# EasyEDA Pro project ProPrj_Avaota A1 八核 AIoT 开发板_2024-05-03.epro, board PCB1 (continued)
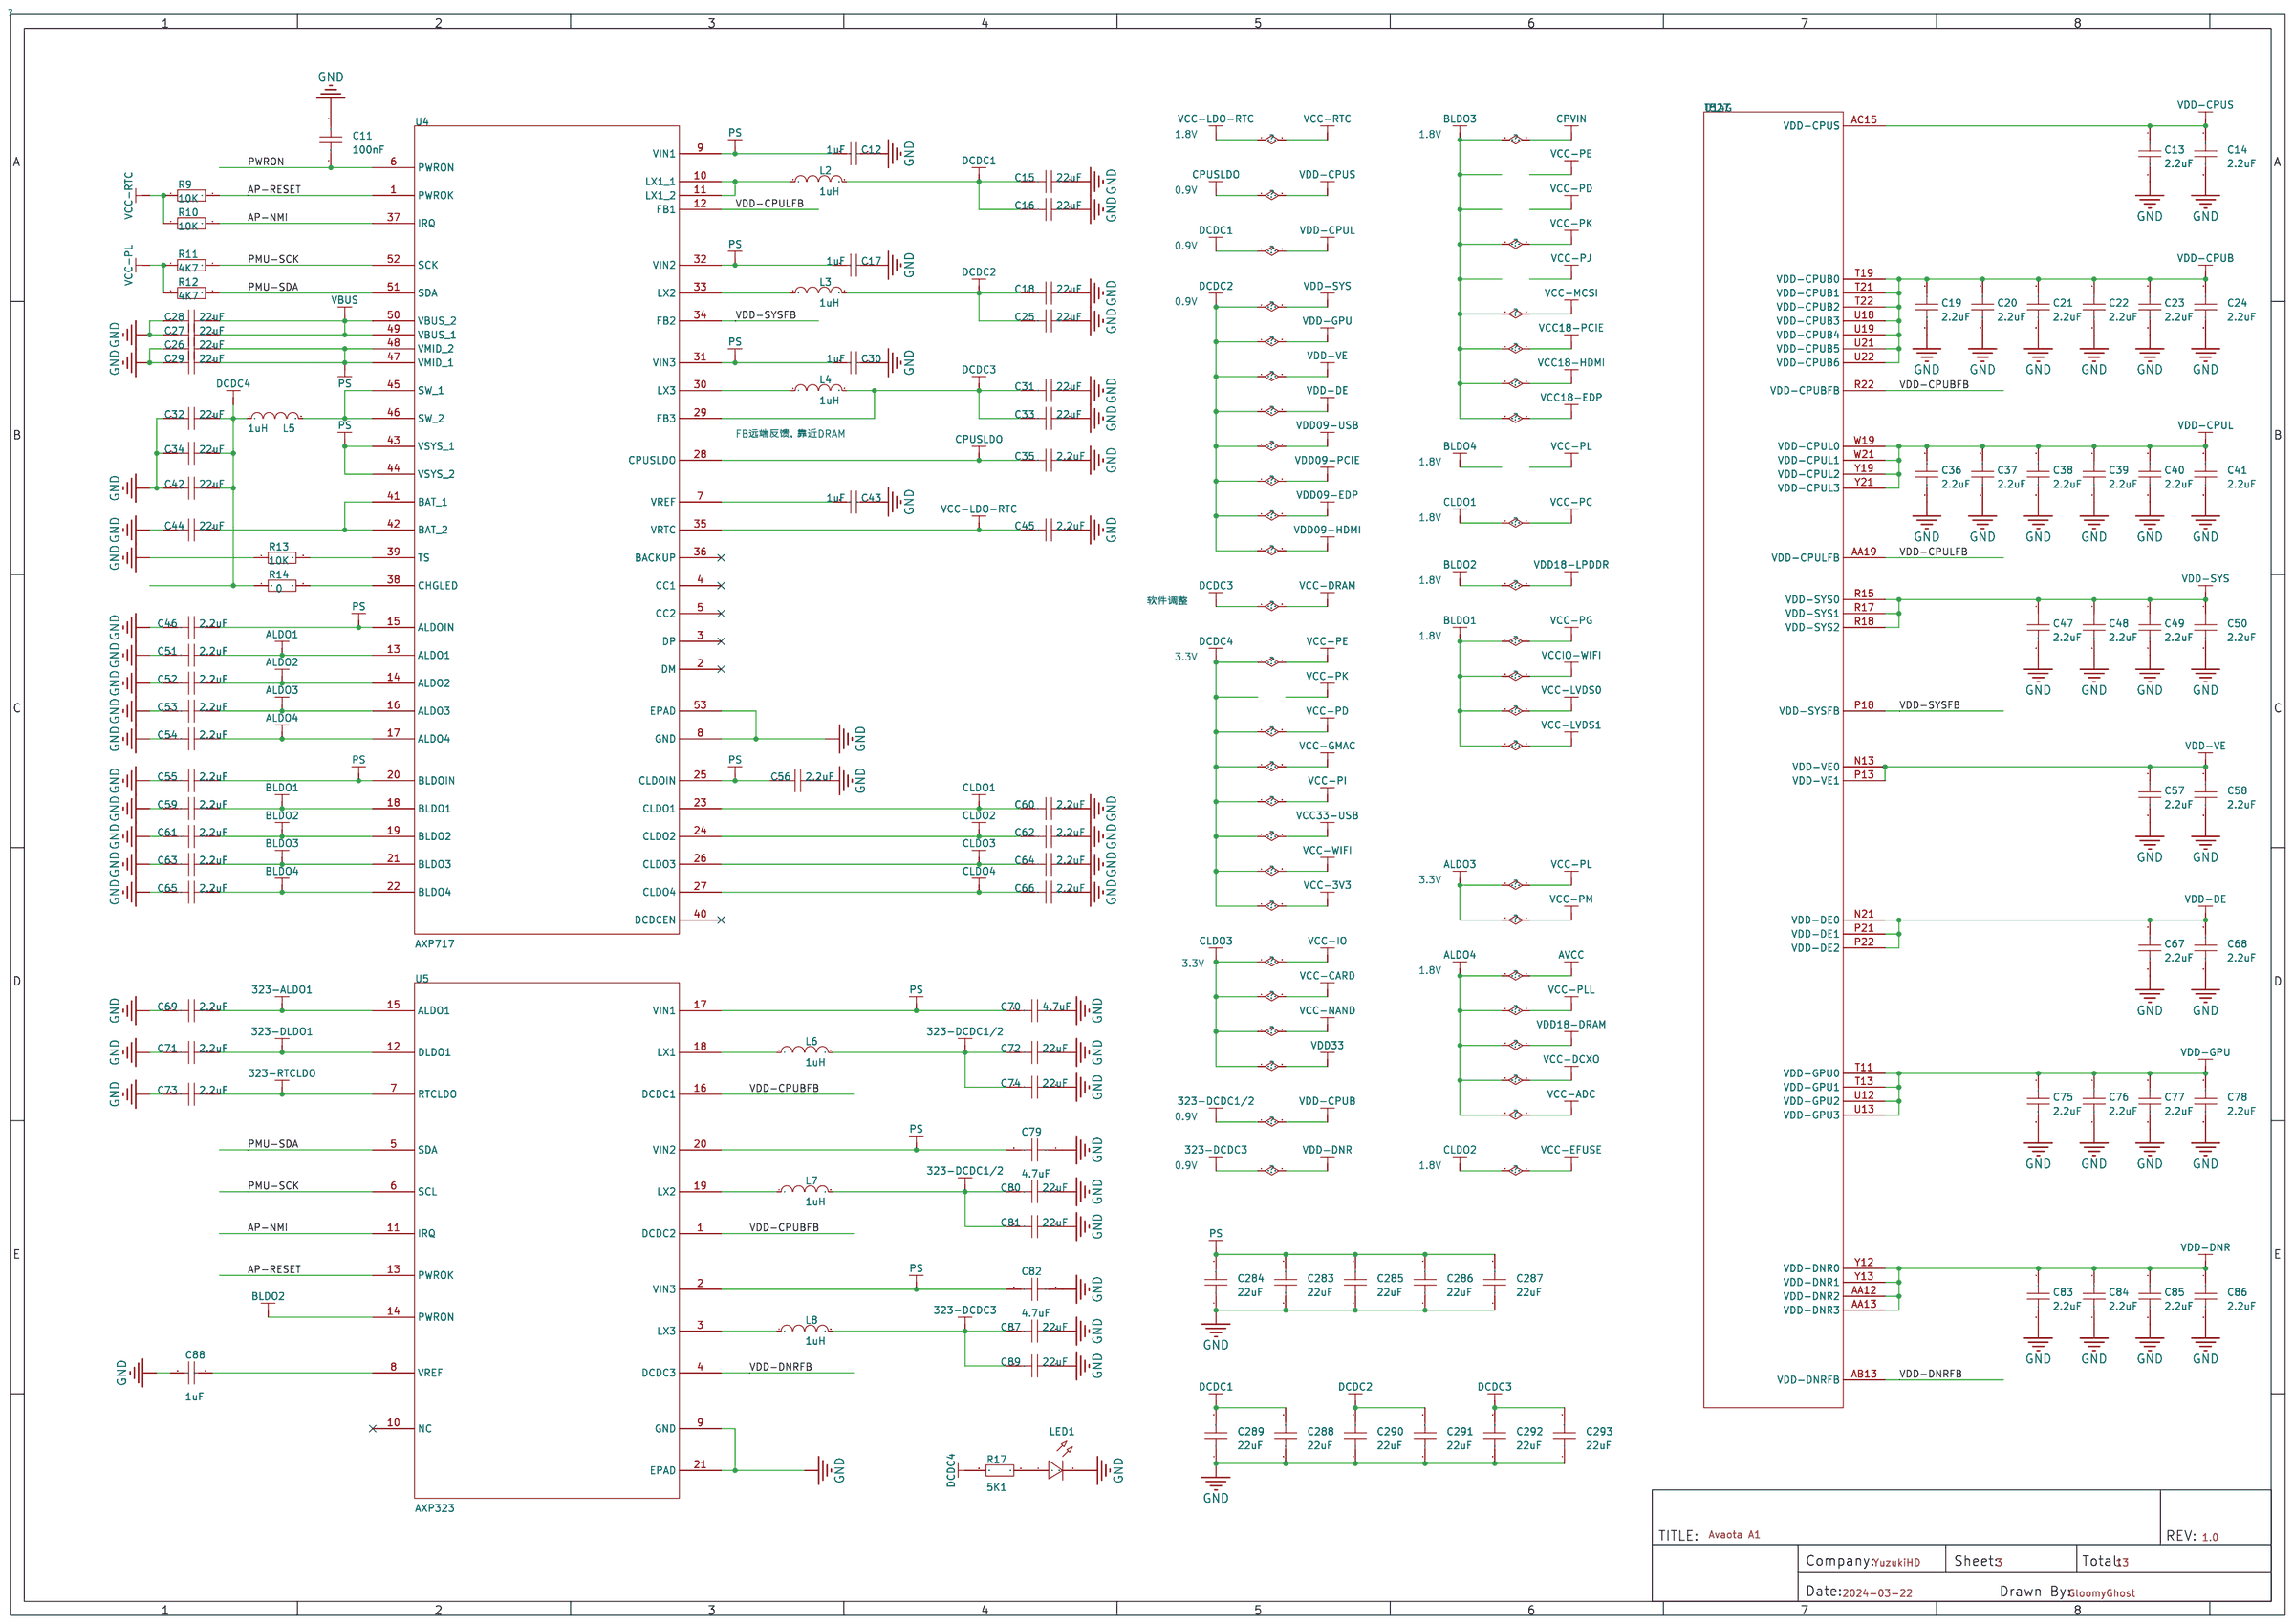
[diagram p0: POWER]
## Footprints (pads in the part's own frame, mm; a bottom-side part is the same pattern mirrored in y, then rotated) (continued)
USB-C-SMD_TYPEC-304-BCP16-1
  oval 1x2.1 hole 0.6x1.7: 12(-4.32,1.633) 13(4.32,1.633)
  oval 1x1.6 hole 0.6x1.2: 14(-4.32,-2.547) 15(4.32,-2.547)
  rect 0.55x1.45 smd: A1B12(-3.225,2.547) A4B9(-2.45,2.547) B1A12(3.225,2.547) B4A9(2.45,2.547)
  rect 0.3x1.45 smd: A5(-1.25,2.547) A6(-0.25,2.547) A7(0.25,2.547) A8(1.25,2.547) B5(1.75,2.547) B6(0.75,2.547) B7(-0.75,2.547) B8(-1.75,2.547)
WQFN-40_L5.0-W5.0-P0.4-BL-EP
  oval 0.2x0.8 smd: 1(-1.801,-2.499) 2(-1.399,-2.499) 3(-1.001,-2.499) 4(-0.6,-2.499) 5(-0.201,-2.499) 6(0.201,-2.499) 7(0.6,-2.499) 8(1.001,-2.499) 9(1.399,-2.499) 10(1.801,-2.499) 21(1.801,2.499) 22(1.399,2.499) 23(1.001,2.499) 24(0.6,2.499) 25(0.201,2.499) 26(-0.201,2.499) 27(-0.6,2.499) 28(-1.001,2.499) 29(-1.399,2.499) 30(-1.801,2.499)
  oval 0.8x0.2 smd: 11(2.499,-1.801) 12(2.499,-1.399) 13(2.499,-1.001) 14(2.499,-0.6) 15(2.499,-0.201) 16(2.499,0.201) 17(2.499,0.6) 18(2.499,1.001) 19(2.499,1.399) 20(2.499,1.801) 31(-2.499,1.801) 32(-2.499,1.399) 33(-2.499,1.001) 34(-2.499,0.6) 35(-2.499,0.201) 36(-2.499,-0.201) 37(-2.499,-0.6) 38(-2.499,-1.001) 39(-2.499,-1.399) 40(-2.499,-1.801)
  rect 3.8x3.8 smd: 41(0,0)
WSON-8_L8.0-W6.10-P1.27-BL-EP
  oval 0.56x1.4 smd: 1(-1.905,-4.027) 2(-0.635,-4.027) 3(0.635,-4.027) 4(1.905,-4.027) 5(1.905,4.027) 6(0.635,4.027) 7(-0.635,4.027) 8(-1.905,4.027)
  rect 4.3x3.4 smd: 9(0,0)

## Nets
As in the schematic, except:
GND: C1.1 C2.1 C3.1 C5.1 C6.1 C7.1 C8.1 C10.2 C11.2 C12.2 C13.2 C14.2 C15.1 C16.1 C17.2 C18.1 C19.2 C20.2 C21.2 C22.2 C23.2 C24.2 C25.1 C26.2 C27.1 C28.1 C29.2 C30.2 C31.1 C32.2 C33.1 C34.2 C35.1 C36.2 C37.2 C38.2 C39.2 C40.2 C41.2 C42.2 C43.2 C44.1 C45.1 C46.2 C47.2 C48.2 C49.2 C50.2 C51.2 C52.2 C53.2 C54.2 C55.2 C56.1 C57.2 C58.2 C59.2 C60.1 C61.2 C62.1 C63.2 C64.1 C65.2 C66.1 C67.2 C68.2 C69.2 C70.1 C71.2 C72.1 C73.2 C74.1 C75.2 C76.2 C77.2 C78.2 C79.1 C80.1 C81.1 C82.1 C83.2 C84.2 C85.2 C86.2 C87.1 C88.2 C89.1 C90.1 C91.1 C92.1 C93.1 C94.1 C95.1 C96.1 C97.1 C98.1 C99.1 C100.1 C101.1 C102.1 C103.1 C104.1 C105.1 C106.1 C107.1 C112.1 C113.1 C114.1 C115.1 C116.2 C117.2 C118.1 C119.1 C120.1 C121.1 C122.1 C123.1 C124.1 C125.1 C126.1 C127.1 C128.1 C129.1 C130.1 C131.1 C132.2 C133.1 C134.2 C135.1 C136.1 C137.1 C138.1 C139.1 C140.1 C141.1 C142.2 C143.2 C144.1 C145.1 C146.1 C147.2 C148.1 C149.1 C150.1 C151.1 C152.1 C153.1 C154.1 C155.1 C156.1 C157.1 C158.1 C159.1 C160.1 C161.2 C162.1 C163.1 C164.1 C165.1 C166.1 C167.1 C168.1 C169.1 C170.1 C171.1 C172.1 C173.1 C174.1 C175.1 C176.1 C177.1 C178.1 C179.1 C180.1 C181.1 C182.1 C183.1 C184.1 C185.1 C186.1 C187.1 C188.1 C189.1 C200.1 C201.1 C202.1 C204.1 C208.1 C209.1 C210.1 C211.1 C213.1 C214.1 C215.1 C216.1 C218.1 C221.1 C222.1 C223.1 C224.1 C225.2 C226.1 C227.1 C228.2 C229.1 C230.1 C231.2 C232.1 C233.1 C234.2 C235.1 C236.1 C237.1 C240.1 C244.1 C245.1 C246.1 C247.1 C248.1 C249.2 C250.2 C251.1 C252.1 C253.2 C254.2 C255.1 C256.2 C257.1 C258.2 C259.1 C260.2 C261.2 C262.2 C263.2 C264.2 C265.2 C266.2 C267.2 C268.1 C269.2 C270.2 C271.2 C272.2 C273.2 C274.2 C275.1 C276.2 C277.1 C280.1 C281.1 C282.1 C283.1 C284.1 C285.1 C286.1 C287.1 C288.1 C289.1 C290.1 C291.1 C292.1 C293.1 C294.1 CGQ1.1 CGQ1.2 CN3.3 CN3.4 CN4.1 CN4.3 CN4.4 D2.1 D4.1 D5.3 D5.8 D6.3 D6.8 D8.3 D8.8 D10.3 D10.8 D11.3 D11.8 D12.3 D12.8 D13.3 D13.8 D14.3 D14.8 D15.3 D15.8 D16.2 D17.1 D18.2 D19.1 D20.2 D21.1 D22.2 D23.1 D24.1 D25.1 D26.1 D27.1 D30.1 D31.1 DC1.2 DC1.3 FEL1.1 FPC1.5 FPC1.6 FPC1.31 FPC1.39 FPC1.44 FPC1.50 FPC1.51 FPC1.52 FPC2.5 FPC2.8 FPC2.11 FPC2.14 FPC2.17 FPC2.20 FPC2.23 FPC2.25 FPC2.29 FPC2.30 FPC2.31 FPC2.32 H1.6 H1.9 H1.14 H1.20 H1.25 H1.30 H1.34 H1.39 LED1.2 LED2.2 LED3.2 LED4.2 LED5.2 NOREF.54 NOREF#2.54 NOREF#3.54 NOREF#4.54 NOREF#5.54 PWR1.1 R2.1 R6.1 R7.2 R8.1 R13.1 R28.1 R33.1 R34.1 R35.1 R44.1 R45.2 R46.1 R49.1 R55.1 R56.1 R57.1 R59.1 R60.1 R62.1 R67.1 R68.1 R76.2 R82.1 R85.1 R86.1 R93.1 R94.1 R95.1 R96.1 R100.1 R103.1 R104.1 R111.1 R112.1 R113.1 R114.1 R115.1 R116.2 R117.2 R118.1 R119.1 R121.1 R122.1 R129.1 R130.1 RESET1.1 RF1.2 RF1.3 RJ1.P10 RJ1.SHIELD0 RJ1.SHIELD1 RJ2.P10 RJ2.SHIELD0 RJ2.SHIELD1 SIM1.6 SIM1.9 SIM1.10 SIM1.12 SIM1.13 SIM1.14 TFT1.8 TFT1.11 TFT1.13 U1.2 U2.2 U3.7 U3.9 U4.8 U4.53 U5.9 U5.21 U8.A6 U8.C4 U8.E7 U8.G5 U8.H10 U8.J5 U8.K8 U8.N2 U8.N5 U8.P4 U8.P6 U9.1 U9.3 U9.20 U9.31 U9.33 U9.36 U11.2 U12.41 U13.41 U14.A1 U14.A32 U14.A33 U14.AA7 U14.AA15 U14.AA16 U14.AA18 U14.AA21 U14.AA22 U14.AA26 U14.AA30 U14.AA32 U14.AB10 U14.AB11 U14.AB12 U14.AB14 U14.AB15 U14.AB17 U14.AC1 U14.AC26 U14.AC29 U14.AC33 U14.AD9 U14.AD11 U14.AD13 U14.AD14 U14.AD20 U14.AD21 U14.AD22 U14.AE9 U14.AE12 U14.AE14 U14.AE18 U14.AE19 U14.AE20 U14.AE21 U14.AE22 U14.AE23 U14.AE24 U14.AE25 U14.AE26 U14.AE29 U14.AE32 U14.AG3 U14.AG6 U14.AG7 U14.AG11 U14.AG25 U14.AG28 U14.AG31 U14.AG33 U14.AH7 U14.AH9 U14.AH27 U14.AH32 U14.AJ13 U14.AJ19 U14.AJ21 U14.AJ23 U14.AK5 U14.AK11 U14.AK32 U14.AL3 U14.AL9 U14.AL12 U14.AL13 U14.AL14 U14.AM5 U14.AM20 U14.AM26 U14.AM29 U14.AN1 U14.AN10 U14.AN11 U14.AN18 U14.AN22 U14.AN24 U14.AN28 U14.AN31 U14.AN33 U14.B21 U14.C6 U14.C8 U14.C10 U14.C12 U14.C14 U14.C18 U14.C20 U14.C21 U14.C22 U14.C24 U14.C26 U14.C28 U14.C30 U14.C31 U14.D6 U14.E3 U14.E29 U14.F6 U14.F8 U14.F10 U14.F12 U14.F22 U14.F24 U14.G3 U14.G8 U14.G10 U14.G14 U14.G18 U14.G26 U14.G28 U14.G29 U14.H24 U14.J3 U14.J6 U14.J9 U14.J10 U14.J12 U14.J13 U14.J17 U14.J21 U14.J22 U14.J23 U14.J26 U14.J28 U14.J31 U14.K9 U14.K10 U14.K11 U14.K12 U14.K15 U14.K16 U14.K21 U14.K22 U14.K24 U14.K25 U14.K26 U14.L3 U14.L6 U14.L10 U14.L12 U14.L13 U14.L16 U14.L19 U14.L24 U14.L27 U14.L30 U14.L33 U14.M13 U14.M16 U14.M18 U14.M19 U14.N3 U14.N6 U14.N10 U14.N12 U14.N15 U14.N18 U14.N19 U14.N22 U14.N26 U14.N27 U14.N30 U14.P11 U14.P16 U14.P19 U14.P24 U14.R3 U14.R7 U14.R11 U14.R13 U14.R19 U14.R24 U14.R27 U14.T15 U14.T16 U14.T18 U14.T24 U14.U7 U14.U14 U14.U16 U14.U25 U14.U27 U14.V18 U14.V19 U14.W12 U14.W13 U14.W15 U14.W16 U14.W22 U14.W27 U14.W30 U14.Y10 U14.Y15 U14.Y18 U14.Y22 U14.Y23 U14.Y26 U15.2 U15.5 U15.8 U15.11 U15.16 U15.19 U15.21 U15.22 U15.23 U15.24 U16.2 U17.2 U18.4 U18.9 UD1.A3 UD1.A10 UD1.AB3 UD1.AB5 UD1.AB8 UD1.AB10 UD1.C1 UD1.C5 UD1.C8 UD1.C12 UD1.D2 UD1.D4 UD1.D9 UD1.D11 UD1.E1 UD1.E5 UD1.E8 UD1.E12 UD1.G1 UD1.G3 UD1.G5 UD1.G8 UD1.G10 UD1.G12 UD1.J1 UD1.J3 UD1.J10 UD1.J12 UD1.K2 UD1.K4 UD1.K9 UD1.K11 UD1.N2 UD1.N4 UD1.N9 UD1.N11 UD1.P1 UD1.P3 UD1.P10 UD1.P12 UD1.T1 UD1.T3 UD1.T5 UD1.T8 UD1.T10 UD1.T12 UD1.V1 UD1.V5 UD1.V8 UD1.V12 UD1.W2 UD1.W4 UD1.W9 UD1.W11 UD1.Y1 UD1.Y5 UD1.Y8 UD1.Y12 USB1.2 USB1.5 USB1.8 USB1.11 USB1.14 USB1.17 USB1.20 USB2.4 USB2.7 USB2.13 USB2.16 USB2.19 USB2.20 USB2.21 USB2.22 USB3.12 USB3.13 USB3.14 USB3.15 USB3.A1B12 USB3.B1A12 X1.2 X1.4 X3.2 X3.4 X4.2 X4.4

Pads without a net: D12 5 6; D13 1 2 9 10; D14 1 2 9 10; DC1 4; FAN 1 2; FEL1 2 4; FPC1 34 45 46 47 48 49; FPC2 1; LED5 1; PWR1 2 4; RESET1 2 4; TFT1 1 2 9; U4 2 3 4 5 36 40; U5 10; U8 A1 A2 A7 A8 A9 A10 A11 A12 A13 A14 B1 B7 B8 B9 B10 B11 B12 B13 B14 C1 C3 C5 C7 C8 C9 C10 C11 C12 C13 C14 D1 D2 D3 D4 D12 D13 D14 E1 E2 E3 E5 E8 E9 E10 E12 E13 E14 F1 F2 F3 F10 F12 F13 F14 G1 G2 G3 G10 G12 G13 G14 H1 H2 H3 H12 H13 H14 J1 J2 J3 J12 J13 J14 K1 K2 K3 K6 K7 K10 K12 K13 K14 L1 L2 L3 L12 L13 L14 M1 M2 M3 M7 M8 M9 M10 M11 M12 M13 M14 N1 N3 N6 N7 N8 N9 N10 N11 N12 N13 N14 P1 P2 P7 P8 P9 P10 P11 P12 P13 P14; U9 4 5 8 10 11 21 23 24 25 26 27 28 29 30 32 35 37 38 39 40; U14 A5 A8 A16 AA1 AA2 AA3 AA4 AA5 AA6 AB2 AB3 AC2 AC3 AC4 AC5 AC6 AD1 AD2 AE1 AE2 AE4 AE5 AE6 AG1 AG2 AG13 AG17 AH1 AH2 AH11 AH13 AH15 AJ1 AJ15 AK1 AK13 AK15 AK33 AL5 AL7 AL11 AL15 AL27 AL32 AL33 AM6 AM7 AM8 AM14 AM15 AM16 AM17 AM18 AM33 AN4 AN7 AN8 AN15 AN17 AN26 B6 B7 B8 B9 B15 C7 C9 C15 F20 G4 G16 J2 M3 N1 N4 N5 N31 N32 N33 U28 U29 U30 U33 W4 W5 W6 W29 Y2 Y3; UD1 A1 A2 A11 A12 AA1 AA12 AB1 AB2 AB11 AB12 B1 B12 G11 K5 K8 N5 N8; USB2 5 6 8 9

## Via types
v1: diameter 0.4, hole 0.299, Top Layer to Bottom Layer, 496 vias
v2: diameter 0.399, hole 0.299, Top Layer to Bottom Layer, 335 vias
v3: diameter 0.4, hole 0.3, Top Layer to Bottom Layer, 279 vias
v4: diameter 0.61, hole 0.305, Top Layer to Bottom Layer, 5 vias

## Routing (per net, layer and track width the routed paths; a pad name or vN(x,y) marks a point on that pad's centre or on a via; arc(x,y) is an arc through that point)
AGND: length 3.5
  Top Layer w0.152: v1(57.92,55.15) U14.AE3
  Bottom Layer w0.152: C110.1 58.52,54.64 C111.1 59.04,54.65 59.14,54.55 ; C110.1 57.99,55.08 v1(57.92,55.15) ; C110.1 C109.1 ; 59.14,54.55 R28.2 ; 59.14,54.55 C108.1
GND: length 1105.6
  Top Layer w0.076: 71.05,44.25 72.29,44.25 v2(72.31,44.22) ; 68.68,42.41 68.69,42.16 68.68,41.88 U14.C30 ; 68.68,42.41 U14.C28 ; 68.68,42.41 68.68,42.41 ; 68.68,42.41 68.68,42.41 ; 56.43,41.14 56.68,40.89 56.68,40.53 56.43,40.28 ; U14.A32 69.31,40.65 69.06,40.89 68.69,40.89 U14.C31 ; 53.01,43.39 53.68,43.39 53.93,43.64 ; 69.92,43.23 69.9,43.25 ; 68.44,51.64 68.69,51.39 ; 68.69,51.39 69.64,51.39 69.82,51.58 ; 68.69,51.39 68.69,51.39 68.69,50.89 U14.C12 ; 68.45,49.61 68.67,49.39 69.04,49.39 69.22,49.21 69.97,49.21 v1(70.08,49.33) ; 53.93,42.14 53.68,41.89 53.33,41.89 53.33,41.89 53.25,41.81 52.98,41.81 ; U14.C10 68.69,51.9 68.69,52.39 68.44,52.64 ; v2(73.53,53.47) 70.49,53.47 69.91,52.89 68.69,52.89 68.44,52.64 ; 39.59,47.82 UD1.N4 ; 39.59,47.82 37.51,47.82 v3(37.06,48.41) ; 39.59,47.82 40.1,47.82 ; UD1.N4 40.1,47.82 ; UD1.N4 v3(40.23,48.43) ; 62.2,57.01 62.2,56.85 v1(62.2,56.85) 62.23,56.37 62.2,56.13 62.2,56.07 62.21,55.9 62.19,55.7 62.19,55.42 62.43,55.18 ; 59.44,40.65 59.68,40.93 59.69,41.28 v3(59.9,41.59) ; 68.44,52.64 U14.C8 ; 64.45,55.13 64.7,55.38 64.7,55.77 64.87,55.94 64.87,56.35 64.77,56.45 64.77,57.26 64.85,57.33 ; 40.1,47.82 43.69,47.82 43.86,47.84 46.4,45.29 46.4,45.06 48.99,42.47 51.59,42.47 51.66,42.54 52.73,42.54 52.74,42.53 v3(52.79,42.53) ; 68.44,47.64 68.69,47.39 69.05,47.39 69.22,47.23 69.84,47.23 70.03,47.41 v1(70.24,47.41) ; U14.AN10 53.28,51.65 52.96,51.97 52.65,51.97 52.45,51.77 52.45,51.3 52.55,51.2 ; 70.59,46.33 70.62,46.36 70.75,46.36 70.89,46.51 v1(71.09,46.51) ; U8.N2 36.91,35.62 36.91,36.04 ; 56.61,39.42 56.7,39.42 57.18,39.91 57.18,40.28 57.43,40.54 57.43,40.64 ; v3(54.46,39.01) 54.46,39.06 55.12,39.73 55.93,39.73 56.18,39.98 56.19,39.98 56.35,40.14 56.43,40.14 ; 65.44,55.14 65.69,55.39 65.69,55.77 65.8,55.88 65.8,56.66 v1(65.94,56.79) ; 63.4,56.72 63.2,56.52 63.2,55.38 63.44,55.14 ; 53.93,46.64 53.68,46.89 53.07,46.89 ; 68.44,43.64 68.69,43.4 69.05,43.4 69.2,43.25 arc(69.25,43.25) 69.29,43.24 arc(69.38,43.22) 69.47,43.22 arc(69.81,43.22) v1(70.16,43.18) ; v3(49.07,45.47) 49.43,45.8 50.57,45.8 v3(50.8,45.47) ; 64.44,40.14 64.28,39.81 64.23,39.66 64.25,39.32 v1(64.08,38.86) ; v3(36.17,47.33) 36.33,47.18 36.63,47.18 36.65,47.16 43.54,47.16 45.64,45.06 45.64,44.75 48.72,41.68 52.07,41.68 v3(52.19,41.81) ; 54.51,39.85 54.68,40.03 54.68,40.39 54.93,40.64 ; 71.04,44.23 arc(70.87,44.22) 70.7,44.23 arc(70.67,44.24) 70.64,44.24 70.36,44.24 arc(70.22,44.24) 70.09,44.24 69.22,44.24 69.07,44.39 arc(69.04,44.39) 69,44.39 arc(68.72,44.46) 68.47,44.62
  Top Layer w0.102: v1(57.56,59.79) R35.1 R33.1 ; 51.74,47.73 49.98,47.73 49.91,47.8 v3(48.36,47.8) ; 51.36,51.25 C99.1 50.53,51.02 X1.4 ; 51.36,51.25 51.64,50.97 v1(51.64,50.72) ; 51.36,51.25 arc(51.36,51.77) 51.36,52.3 ; 51.36,52.3 51.35,52.31 C100.1 ; 51.36,52.3 arc(51.36,52.39) 51.36,52.48 arc(51.36,52.91) 51.36,53.34 ; 51.33,44.29 51.36,44.29 51.45,44.38 52.4,44.38 52.8,44.78 v3(52.91,44.78) ; v1(44.75,19.63) 44.58,19.81 D6.8 D6.3 v1(44.58,21.79) ; 56.43,40.28 56.43,40.14 ; C101.1 51.23,55.16 51.23,54.22 51.26,54.2 51.54,54.2 52.04,53.69 52.04,51.48 52.32,51.2 52.55,51.2 52.65,51.1 53.4,51.1 U14.AN11 ; v1(47.45,19.76) D5.8 ; R34.1 v1(59.23,59.82) ; v3(56.07,39) 56.07,39.05 56.44,39.42 56.61,39.42 ; v1(62.76,22.56) 62.67,22.64 C252.1 61.73,22.64 61.49,22.4 ; 66.95,55.15 U14.G3 ; v2(36.91,36.6) 36.91,36.04 ; v1(66.95,55.14) 67.44,55.14 ; v1(47.45,21.79) D5.3
  Top Layer w0.115: 53.43,45.64 53.38,45.59 ; 53.38,45.59 53.39,45.59 U14.AN22 ; 53.38,45.59 52.63,45.59 52.07,45.03 51.2,45.03 50.8,45.44 v3(50.8,45.47)
  Top Layer w0.127: 64.85,57.33 v1(64.99,57.47) ; D15.8 D15.3 ; C266.2 v1(67.61,17.7) ; 33.92,49.72 34.58,49.72 v3(34.59,49.71) ; v1(65.58,17.7) C267.2 ; D10.8 D10.3 ; D13.8 D13.3 ; v3(36.23,50.43) 36.18,50.38 35.41,50.38 v3(35.38,50.42) ; v3(52.19,41.81) 52.26,41.81 52.27,41.81 52.98,41.81 ; 41.41,46.15 41.71,46.46 43.13,46.46 44.88,44.7 44.88,44.48 48.46,40.89 52.74,40.89 ; U8.P4 35.81,34.03 35.81,33.63 ; 35.81,33.63 35.23,34.21 35.23,35.87 v2(34.44,36.65) ; 35.81,33.63 36.06,33.39 U8.P6 U8.N5 ; D11.8 D11.3 ; v1(50.14,22.33) D12.3 50.14,23.88 ; v3(49.6,46.65) 49.06,46.65 48.94,46.53 48.49,46.53 48.16,46.86 48.16,47.62 48.33,47.8 v3(48.36,47.8) ; 35.81,48.1 35.81,47.7 ; U14.C31 U14.C30 ; v1(83.79,17.68) C275.1 ; v1(51.46,24.56) 51.37,24.56 R60.1 51.22,24.8 ; D8.3 D8.8 ; 39.35,49.71 40.11,49.71 v3(40.21,49.61) ; v1(85.78,17.68) C272.2 ; v3(52.09,43.23) 52.24,43.38 53,43.38 53.01,43.39 ; 34.41,44.51 33.81,44.51
  Top Layer w0.152: C274.2 87.82,27.11 88.06,26.87 88.06,26.34 86.92,25.2 86.92,24.46 84.76,22.3 U13.41 ; 8.47,47.41 v1(8.47,47.04) ; 8.47,47.41 8.46,47.42 ; 8.47,47.41 C43.2 ; 76.25,7.14 R112.1 ; 76.25,7.14 v1(76.25,7.24) ; 76.25,7.14 76.25,7.12 R114.1 ; C15.1 C16.1 v2(14.99,47) ; U14.AG28 56.87,42.22 ; 56.87,42.22 v3(56.94,41.66) U14.AG31 ; 56.87,42.22 U14.AE29 v3(57.91,42.42) ; v1(7.29,47.37) 6.82,47.37 C95.1 ; C69.2 17.7,41.15 v2(17.53,41.33) ; U14.A33 69.61,40.15 v1(69.85,40.39) 69.59,40.65 U14.A32 ; U8.A6 43.32,33.39 43.46,33.25 ; 54.51,39.85 54.14,39.85 53.35,39.07 53.35,39.03 v3(53.34,39.03) ; U14.R13 62.83,49.76 63.56,49.76 U14.M13 ; v3(34.52,41.94) 35.15,41.91 35.28,41.94 ; TFT1.8 90.1,44.31 90.4,44.6 90.4,45.8 v2(90.02,46.18) ; 50.22,56.41 50.91,55.72 C101.1 ; U14.T15 U14.T16 ; v2(58.98,53.14) 59.43,53.14 U14.AA7 ; U14.Y22 U14.AA22 U14.AA21 ; U14.Y22 U14.Y23 ; U14.Y22 U14.W22 ; 53.07,46.89 52.86,46.89 52.58,46.61 52.04,46.61 51.76,46.89 49.84,46.89 v3(49.6,46.65) ; v2(66.42,51.13) 66.42,51.11 66.88,50.65 U14.F12 ; v3(37.59,45.97) 37.87,45.97 38.36,46.46 39.28,46.46 v3(39.44,46.3) 39.6,46.46 40.07,46.46 40.16,46.38 40.24,46.46 41.09,46.46 41.41,46.15 ; C64.1 C66.1 ; C64.1 14.01,55.07 C35.1 ; C64.1 C12.2 C62.1 C60.1 C65.2 C63.2 C17.2 C61.2 C59.2 C54.2 C53.2 C55.2 C52.2 C51.2 v2(14.99,47.83) ; R62.1 48.56,25.91 48.92,26.26 v2(49.38,26.26) ; 78.33,48.95 79.07,48.21 81.59,48.21 81.79,48.41 81.79,48.9 81.59,49.1 v2(80.85,49.1) ; 51.33,44.29 49.97,44.29 49.07,45.19 v3(49.07,45.47) ; v3(36.17,47.33) 35.81,47.7 ; v2(78.33,23.01) 79.1,23.01 79.96,22.15 80.25,22.15 80.49,22.39 C259.1 ; U8.C4 41.29,34.01 41.1,34.01 40.82,34.29 40.07,34.29 U8.G5 ; 60.43,41.64 59.96,41.64 v3(59.9,41.59) ; U14.T18 U14.R19 ; U5.9 14.52,42.61 14.25,42.34 13.97,42.34 13.72,42.6 13.72,44.2 13.98,44.46 C73.2 ; U14.C20 U14.C21 U14.B21 69.64,46.15 69.82,46.33 70.59,46.33 ; R113.1 R111.1 84.24,27.13 C256.2 C258.2 ; 53.41,41.12 53.16,41.12 ; R104.1 R100.1 ; v3(48.36,47.8) 48.79,48.23 51.97,48.23 52.56,47.65 U14.AN18
  Top Layer w0.178: v2(83.24,27.58) C258.2
  Top Layer w0.203: v1(63.55,57.53) 63.4,57.38 63.4,56.72 ; U14.AB12 U14.AB11 U14.AB10 U14.Y10 ; 52.74,40.89 52.93,40.89 53.16,41.12 ; C291.1 3.54,57.11 R13.1 ; C45.1 v2(5.31,56.85) ; 42.27,45.5 42.35,45.5 42.47,45.38 43.04,45.38 43.15,45.49 43.2,45.49 v3(43.2,45.5) ; v3(37.74,44.73) 37.21,44.2 36.61,44.2 ; v1(9.44,48.32) 9.35,48.41 9.17,48.41 9.06,48.52 U4.8 ; v3(37.72,41.33) 37.51,41.53 36.68,41.53 36.61,41.6 ; v3(52.67,39.03) 52.69,39.05 52.69,39.23 53.42,39.96 53.42,40.12 53.43,40.13 53.43,40.14 ; v1(16.25,43.01) v1(15.85,42.61) U5.9 ; 42.21,48.75 42.43,48.97 44.13,48.97 v3(44.36,48.74) ; U14.AD13 U14.AD14 U14.AE14 ; 71.05,44.25 71.08,44.22 v2(72.31,44.22) ; 35.81,42.25 35.59,42.25 35.28,41.94 ; 68.44,45.63 68.44,46.14 68.42,46.16 ; 53.43,42.64 52.93,42.64
  Top Layer w0.254: v1(69.67,56.41) 69.67,56.38 U14.A1 ; 56.12,43.14 56.43,42.83 56.43,42.64 ; 56.12,43.14 55.93,43.14 ; 56.12,43.14 56.59,43.61 v3(56.59,43.67) 56.59,44 U14.AG25 ; v1(57.44,46.64) v1(57.44,47.15) v1(57.44,47.64) ; v1(57.44,46.64) U14.AD20 ; v1(57.44,46.64) v1(57.44,46.15) ; 52.93,42.64 52.89,42.6 52.89,42.6 52.82,42.53 v3(52.79,42.53) ; v3(39.44,46.3) 39.65,46.3 39.81,46.15 ; 67.96,27.24 68.55,27.24 ; 40.61,44.2 40.53,44.2 40.23,44.5 v3(40.23,44.53) ; 35.81,52 35.87,52 v3(36.22,52.35) 36.52,52.65 36.61,52.65 ; 10.62,39.98 C10.2 ; 58.29,56.63 58.44,56.48 58.44,56.14 ; U14.J6 U14.L6 v1(63.93,53.65) ; U14.K16 U14.J17 65.94,48.15 U14.G18 ; U14.K16 U14.K15 ; U14.K16 U14.L16 U14.M16 63.35,48.65 ; v3(36.47,54.38) 36.55,54.38 36.61,54.32 36.61,53.95 ; U14.M19 U14.M18 ; U14.M19 U14.N19 ; U14.M19 U14.L19 ; U14.N19 U14.N18 63.44,48.56 63.35,48.65 ; U14.N19 U14.P19 U14.R19 ; v1(55.88,22.38) 55.88,22.98 D10.8 ; 35.43,50.47 v3(35.38,50.42) 34.67,49.72 34.6,49.72 v3(34.59,49.71) 34.59,49.28 35.01,48.86 35.01,48.75 35.25,48.75 35.81,48.19 35.81,48.1 ; U14.R27 U14.N27 ; U14.N27 U14.L27 64.79,43.15 64.97,43.33 64.97,43.61 U14.K26 U14.K25 ; U14.N27 U14.N26 ; R7.2 10.62,40.21 10.9,40.49 12.8,40.49 13.38,39.91 R8.1 ; U14.J28 U14.J26 ; v3(32.99,41.27) 33.08,41.27 33.65,41.84 33.74,41.84 v3(33.78,41.88) 33.84,41.88 34.21,42.25 ; 34.41,44.51 34.56,44.51 v3(34.59,44.48) 34.73,44.48 35.01,44.2 35.05,44.2 v3(35.33,43.92) ; v3(33.77,45.91) 33.77,45.87 33.41,45.5 ; v3(33.77,45.91) 33.78,45.91 33.79,45.92 33.83,45.92 34.05,46.15 34.21,46.15 ; v3(33.77,45.91) 33.78,45.92 v3(33.78,46.71) ; 54.73,38.56 55.8,38.56 ; 54.73,38.56 54.46,38.84 v3(54.46,39.01) ; 54.73,38.56 53.52,38.56 53.34,38.74 53.34,39.02 v3(53.34,39.03) ; 55.8,38.56 56.07,38.82 v3(56.07,39) ; 55.8,38.56 58.04,38.56 58.16,38.68 v3(58.16,38.96) 58.06,39.06 58.06,39.77 58.43,40.14 ; 33.41,52.65 33.75,52.3 v3(33.81,52.3) 34.12,52 34.21,52 ; v3(41.73,46) 41.7,46.03 41.52,46.03 41.41,46.15 ; v3(37.09,51.3) 37.06,51.3 37.06,51.31 37.01,51.31 36.97,51.35 36.61,51.35 ; U14.N15 v2(62.94,48.65) 63.35,48.65 ; U14.K12 U14.L12 U14.L13 U14.M13 U14.N12 63.44,50.91 63.21,51.15 U14.P11 ; U14.K12 U14.K11 U14.K10 ; U14.K12 U14.J12 ; 32.23,44.34 32.86,44.34 v3(32.93,44.26) 33,44.2 33.5,44.2 33.77,44.47 ; v3(42.85,43.84) 42.49,44.2 42.21,44.2 ; 69.82,51.58 v1(70.35,51.58) ; 39.81,42.25 40.18,41.87 v3(40.18,41.33) ; v2(42.01,19.61) 41.71,19.91 D8.3 ; v3(57.91,42.42) 58.19,42.14 58.43,42.14 ; U14.N30 v1(63.95,41.65) U14.L30 64.94,41.65 U14.J31 ; C158.1 32.5,48.4 v3(32.76,48.67) ; C208.1 61.44,49.52 v2(61.44,48.65) ; U14.AK5 v2(54.44,54.65) ; v2(54.44,54.65) U14.AL3 ; v2(54.44,54.65) U14.AM5 ; v3(52.91,44.78) 53.02,44.66 53.41,44.66 53.43,44.64 ; v3(33.74,49.71) 33.74,49.72 33.41,50.05 33.41,50.02 33.09,49.71 v3(32.76,49.71) 32.76,49.63 32.94,49.46 32.94,49.22 33.72,48.44 v3(33.87,48.44) 34.21,48.1 33.83,47.72 v3(33.83,47.65) 33.78,47.6 v3(33.78,46.71) ; U14.F24 U14.F22 v1(66.94,46.13) ; 33.92,49.72 33.74,49.72 ; U14.AB17 U14.AA16 U14.AA15 ; U14.L10 U14.K10 ; U14.K10 U14.J10 ; U14.K10 U14.K9 ; U14.P11 U14.N10 ; U14.P11 U14.R11 ; v1(62.94,53.09) 62.88,53.15 U14.R7 v1(61.95,53.15) U14.U7 ; 69.92,43.23 70.11,43.23 v1(70.16,43.18) ; U14.J13 U14.J12 ; U14.J12 65.44,51.1 ; 33.77,44.47 v3(33.81,44.47) ; 33.77,44.47 33.81,44.51 ; U14.J10 U14.G10 ; U14.J10 U14.J9 65.44,52.62 v2(65.43,52.63) ; U14.J10 65.44,51.1 ; U14.G10 U14.F10 66.94,52.11 v2(66.93,52.12) 66.93,52.63 U14.F8 ; U14.G10 66.44,51.15 v2(66.42,51.13) 66.39,51.1 65.44,51.1 ; 39.01,52.65 38.4,53.25 v3(38.4,53.26) ; 35.01,53.95 35.25,54.2 v3(35.25,54.41) ; U14.J21 U14.K21 U14.K22 U14.J22 U14.J23 ; v3(34.63,40.62) 34.96,40.3 35.01,40.3 ; v1(68.45,54.15) 68.44,54.14 U14.C6 U14.D6 ; v3(42.65,52.43) 42.44,52.65 42.1,52.65 41.85,52.4 v3(41.78,52.4) 41.78,52.37 41.41,52 ; v3(55.5,44.7) 55.43,44.77 55.43,45.59 v3(55.5,45.66) 55.5,46.08 55.43,46.14 55.43,46.63 v3(55.49,46.69) 55.49,47.08 55.43,47.14 ; U14.U27 61.3,43.15 60.99,43.46 v2(60.99,44.15) U14.U25 U14.T24 U14.R24 U14.P24 62.94,45.09 63.44,45.59 U14.N22 ; v1(57.44,46.15) v1(57.44,45.64) ; v1(57.44,46.15) U14.AD21 ; v1(57.44,45.64) v1(57.44,45.15) v1(57.44,44.65) v1(57.44,44.15) U14.AE26 ; v1(57.44,45.64) U14.AD22 ; C253.2 61.59,25.71 61.39,25.71 61.14,25.96 61.14,27.29 61.33,27.48 C254.2 62.08,27.94 64.92,27.94 65.18,27.69 65.18,27.33 C250.2 C249.2 66.71,27.28 66.75,27.24 ; v2(65.91,52.63) 66.43,52.63 U14.G8 U14.F8 ; v3(42.8,50.24) 42.6,50.05 42.21,50.05 ; 39.01,51.35 39.01,51.26 38.75,51 38.49,51 38.22,50.74 v3(38.22,50.72) ; 56.92,55.15 U14.AG3 ; U14.F6 66.95,53.63 v1(66.95,53.14) 66.95,52.66 U14.F8 ; U14.K25 U14.K24 U14.H24 ; U14.K25 U14.L24 ; U14.AB14 U14.AB15 U14.AA15 ; U14.AE9 U14.AD9 ; U14.AE9 57.45,52.16 v2(57.45,52.65) ; U14.AE9 57.94,51.65 U14.AD11 U14.AB11 ; 42.21,51.35 42.57,51.35 42.59,51.33 42.7,51.33 42.71,51.32 v3(42.72,51.32) ; 39.01,44.2 38.58,44.2 v3(38.45,44.32) ; v1(54.44,49.65) U14.AL13 U14.AL12 U14.AK11 54.94,51.15 v2(54.43,51.66) 54.44,51.67 U14.AL9 ; 39.81,52 40.18,51.62 40.18,50.98 v3(40.21,50.95) 40.2,50.95 40.2,50.45 40.61,50.05 40.21,49.65 40.21,49.61 v3(40.21,49.61) 40.18,49.58 40.18,49.17 40.6,48.75 ; 35.81,46.15 35.53,45.87 35.38,45.87 v3(35.35,45.85) 35.01,45.5 ; U14.AA15 U14.Y15 U14.W15 ; v3(33.78,46.71) 33.6,46.53 32.99,46.53 32.5,46.04 C148.1 C149.1 ; v2(61.44,48.65) 60.94,48.14 ; v2(61.44,48.65) U14.T16 ; 58.43,43.64 60.24,43.64 60.5,43.38 60.5,43.21 60.43,43.14 ; v3(38.56,41.33) 38.73,41.33 39.01,41.6 ; v1(70.24,47.41) 70.25,47.42 ; U8.E7 U8.H10 38.74,30.96 38.02,30.96 37.79,31.19 37.79,32 38.17,32.38 U8.K8 38.73,32.95 v2(38.73,33.22) 39.01,33.49 39.01,33.55 ; U14.N6 63.93,53.65 ; v3(40.84,54.56) 40.61,54.32 40.61,53.95 ; U14.AG6 U14.AG7 U14.AH7 55.94,52.64 55.93,52.63 55.94,52.62 v2(55.94,52.15) ; v3(40.21,45.85) 40.55,45.5 40.61,45.5 ; 59.43,41.64 59.49,41.59 v3(59.9,41.59) ; U14.G28 U14.G29 66.92,42.15 v1(66.93,42.14) 67.44,42.14 U14.E29 ; v3(37.16,42.87) 37.13,42.9 36.61,42.9 ; 60.94,48.15 U14.V18 U14.V19 ; 60.94,48.15 U14.W16 ; U14.Y10 59.94,51.4 60.44,50.9 U14.W12 U14.W13 ; 41.41,48.1 41.49,48.1 v3(41.68,48.29) ; v1(55.44,49.68) U14.AJ13 U14.AG11 56.94,51.15 U14.AE12 57.3,50.65 57.02,50.37 57.02,50.06 U14.AE14 ; v3(40.44,39.85) 40.49,39.89 40.49,40.18 40.61,40.3 ; 41.41,42.25 41.56,42.25 41.81,41.99 41.81,41.99 v3(41.82,41.98) 41.82,41.98 42.21,41.6 42.74,41.6 43.05,41.91 v3(43.05,41.93) ; 32.23,42.46 32.23,43.14 32.6,42.77 v3(32.81,42.77) 32.94,42.9 33.41,42.9 ; 60.48,20.88 61.06,20.29 C265.2 ; 39.01,42.9 38.65,43.26 38.38,43.26 37.89,43.74 v3(37.82,43.74) ; 39.01,33.55 39.08,33.48 39.26,33.48 U8.G5 ; 39.01,33.55 38.67,33.89 ; U14.AN1 53.25,56.34 v1(53.11,56.34) ; 42.21,42.9 42.43,42.9 v3(42.58,43.05) ; 56.43,40.14 55.93,40.64 ; v3(37.36,54.08) 38.88,54.08 39.01,53.95 ; 32.23,40.09 32.23,40.65 ; v3(38.66,49.88) 38.84,49.88 39.01,50.05 39.35,49.71 ; v3(32.74,51.62) 33.01,51.35 33.41,51.35 ; 36.61,50.05 v3(36.23,50.43)
  Top Layer w0.508: CN4.1 17.69,29.33 R6.1 ; USB3.A1B12 89.05,68.55 USB3.12 ; USB3.13 81.51,69.46 USB3.B1A12
  GND1 w0.076: 35.18,42.21 35.22,42.21 35.25,42.24 35.51,42.24 35.53,42.21 35.63,42.21 ; 34.41,50.65 34.47,50.6 34.77,50.6 34.82,50.65
  内层2 w0.152: v2(54.44,26.26) 54.44,26.54 58.79,30.89 67.67,30.89 68.83,32.06 68.83,33.73 71.73,36.63 74.24,36.63 v2(74.78,37.16) ; v2(73,30.89) 73,30.61 72.36,29.97 59.36,29.97 55.98,26.59 55.98,26.3 55.94,26.26 v2(55.88,26.26) ; v2(53.01,26.29) 58.45,31.72 67.26,31.72 68,32.46 68,33.96 71.52,37.48 71.8,37.48 v2(71.91,37.59)
  内层4 w0.152: v2(45.97,21.9) 45.97,22.89 46.96,23.88 46.96,26.75 48.41,28.19 59.03,28.19 60.5,29.67 69.34,29.67 71.2,27.81 75.87,27.81 78.03,29.97 78.03,40.69 76.58,42.14 75.72,42.14 v1(75.69,42.16) ; v1(75.87,43.13) 76.94,43.13 78.87,41.2 78.87,29.62 76.28,27.03 70.89,27.03 69.24,28.68 60.73,28.68 59.46,27.41 48.87,27.41 47.83,26.37 47.83,22.91 47.45,22.53 v1(47.45,21.79) ; v1(44.58,21.79) 44.58,22.83 46.08,24.33 46.08,27.03 48.08,29.03 58.34,29.03 59.84,30.53 69.75,30.53 71.6,28.68 75.34,28.68 77.22,30.56 77.22,39.98 76.1,41.1 v1(75.82,41.1)
  Bottom Layer w0.102: C30.2 C46.2
  Bottom Layer w0.152: C184.1 51.25,58.87 C183.1 51.25,57.64 52.55,56.34 v1(53.11,56.34) ; C107.1 62.08,55.98 62.33,55.73 62.33,53.42 62.06,53.15 v1(61.95,53.15) ; v2(27.43,17.37) 27.25,17.55 27.25,19.43 27.36,19.53 ; C213.1 C211.1 65.12,51.71 C75.2 C76.2 C78.2 C77.2 ; 87.77,47.76 87.77,48.63 88.11,48.97 88.9,48.97 89.41,48.46 C277.1 ; C226.1 41.85,32.42 C225.2 ; R46.1 R44.1 66.94,45.71 v1(66.94,46.13) ; R55.1 R59.1 ; C174.1 63.41,47.58 63.38,47.55 ; 63.38,47.55 C187.1 ; 63.38,47.55 C49.2 C50.2 62.43,47.52 C24.2 C19.2 61.44,47.6 v2(61.44,48.65) 61.85,49.05 C47.2 61.85,49.11 C208.1 ; C112.1 60.26,52.79 60.07,52.98 59.13,52.98 v2(58.98,53.14)
  Bottom Layer w0.203: v3(40.23,48.43) 40.32,48.34 40.32,47.9 ; v3(33.83,47.65) 34.1,47.92 34.1,48.21 v3(33.87,48.44) ; C46.2 10.16,50.06 v2(9.75,50.06) ; 90.5,18.8 89.38,17.68 v1(85.78,17.68) v1(83.79,17.68) ; v1(76.25,7.24) 76.25,7.42 75.77,7.9 75.77,8.92 75.2,9.49
  Bottom Layer w0.254: C40.2 60.86,48.31 C39.2 ; 64.94,45.54 64.99,45.49 C201.1 ; 64.94,45.54 C175.1 ; 64.94,45.54 C185.1 C186.1 ; 64.94,45.54 65.44,45.54 C176.1 ; C117.2 v3(34.59,44.48) ; 63.32,43.57 63.22,43.57 63.04,43.76 62.68,43.76 C91.1 62.55,43.66 C164.1 C163.1 C227.1 ; v2(74.52,55.12) 74.52,54.94 75.26,54.2 79.93,54.2 84.51,49.63 84.51,41.5 85.55,40.46 FPC2.25 ; 37.99,44.22 38.35,44.22 v3(38.45,44.32) ; 57.91,42.74 57.91,43.06 C133.1 ; 57.91,42.74 57.97,42.8 58.34,42.8 58.42,42.87 58.42,43.65 58.95,43.65 ; 57.91,42.74 v3(57.91,42.42) ; v3(40.18,41.33) 40.37,41.52 40.37,41.91 ; FPC2.8 84.88,31.96 82.78,34.06 82.78,37.57 81.1,39.24 v2(81.1,45.59) 80.62,46.08 80.62,48.79 80.85,49.02 v2(80.85,49.1) ; FPC2.23 93.74,39.46 93.52,39.68 84.48,39.68 83.62,40.54 83.62,49.48 v2(80.52,52.58) 79.63,53.47 v2(73.53,53.47) ; 28.7,18.9 28.7,19.2 35.79,26.29 44.55,26.29 48.18,29.92 75.49,29.92 76.89,31.32 76.89,32.92 v2(75.9,33.91) ; C103.1 57.94,53.48 57.94,53.04 58.32,52.65 ; 34.75,54.27 35.11,54.27 v3(35.25,54.41) ; 39.52,54.28 40.56,54.28 v3(40.84,54.56) ; v2(30.18,18.9) 36.63,25.35 45.09,25.35 48.74,29.01 76.1,29.01 78.89,31.8 78.89,36.55 76.33,39.12 74.7,39.12 73.18,40.64 73.18,43.36 v2(72.31,44.22) ; v2(38.73,33.22) 38.82,33.13 C230.1 ; v1(72.11,35.03) 71.22,35.03 66.88,30.68 47.5,30.68 44.27,27.46 35.28,27.46 27.36,19.53 ; C26.2 4,54.81 3.99,54.82 ; 51.81,43.63 51.66,43.79 51.61,43.79 ; 51.81,43.63 51.81,43.84 52.55,43.84 52.58,43.87 ; 51.81,43.63 51.81,43.51 v3(52.09,43.23) ; 40.03,50.32 40.03,50.78 v3(40.21,50.95) ; 38.21,43.26 37.82,43.65 v3(37.82,43.74) ; v3(42.72,51.32) 42.57,51.47 42.57,51.84 ; v2(60.99,44.15) 60.99,44.56 ; 60.99,44.56 61.95,44.56 C22.2 C21.2 ; 60.99,44.56 60.99,45.03 C20.2 ; C41.2 59.44,46.51 v2(59.44,45.14) ; C181.1 C182.1 54.31,54.78 v2(54.44,54.65) 55.17,54.65 C202.1 ; R28.1 59.72,55.02 59.72,55.68 60.03,55.99 C106.1 ; C188.1 65.18,51.13 C216.1 C215.1 ; C174.1 63.41,48.65 v2(62.94,48.65) 63.41,49.11 C173.1 ; C102.1 57.54,52.57 v2(57.45,52.65) 58.32,52.65 ; 39.88,45.46 39.88,45.52 v3(40.21,45.85) ; 33.29,40.66 33.29,40.97 v3(32.99,41.27) ; C68.2 C215.1 ; C215.1 C104.1 ; v3(34.52,41.94) 34.64,41.81 35.33,41.81 35.58,42.06 36.1,42.06 ; C172.1 56.48,55.03 56.59,55.14 v2(56.92,55.14) ; v2(72.54,52.48) 79.22,52.48 v2(80.62,51.08) 82.58,49.12 v2(82.58,45.59) 82.55,45.57 82.55,39.6 83.9,38.25 83.9,35.05 85.49,33.46 FPC2.11 ; 42.38,43.87 42.4,43.84 v3(42.85,43.84) 43.23,44.22 43.33,44.22 ; C67.2 C57.2 C58.2 ; 58.32,52.65 C113.1 ; SIM1.6 98.5,61.01 v1(97.71,60.22) ; v3(60.45,43.15) 60.5,43.21 60.5,43.43 60.28,43.65 59.94,43.65 ; 35.42,44.4 35.42,44.01 v3(35.33,43.92) ; C79.1 C29.2 4.77,51.94 C42.2 ; v3(42.58,43.05) 42.73,43.2 43.2,43.2 ; v3(35.35,45.85) 35.61,45.85 36.02,46.26 36.07,46.26 ; v1(61.06,18.24) 61.59,17.7 v1(65.58,17.7) v1(67.61,17.7) ; v3(38.66,49.88) 38.66,49.78 38.22,49.34 ; 36.09,50.99 36.09,50.57 v3(36.23,50.43) ; 40.51,39.27 40.54,39.3 40.54,39.75 v3(40.44,39.85) ; v2(61.44,48.65) 61.2,48.89 C86.2 C83.2 C84.2 58.62,48.89 58.3,49.21 57.89,49.21 57.88,49.2 C93.1 C90.1 56.81,50.23 C14.2 56.76,50.27 C13.2 ; C94.1 v2(54.43,51.66)